# EAGLE design TM (EAGLE 6.5.0)
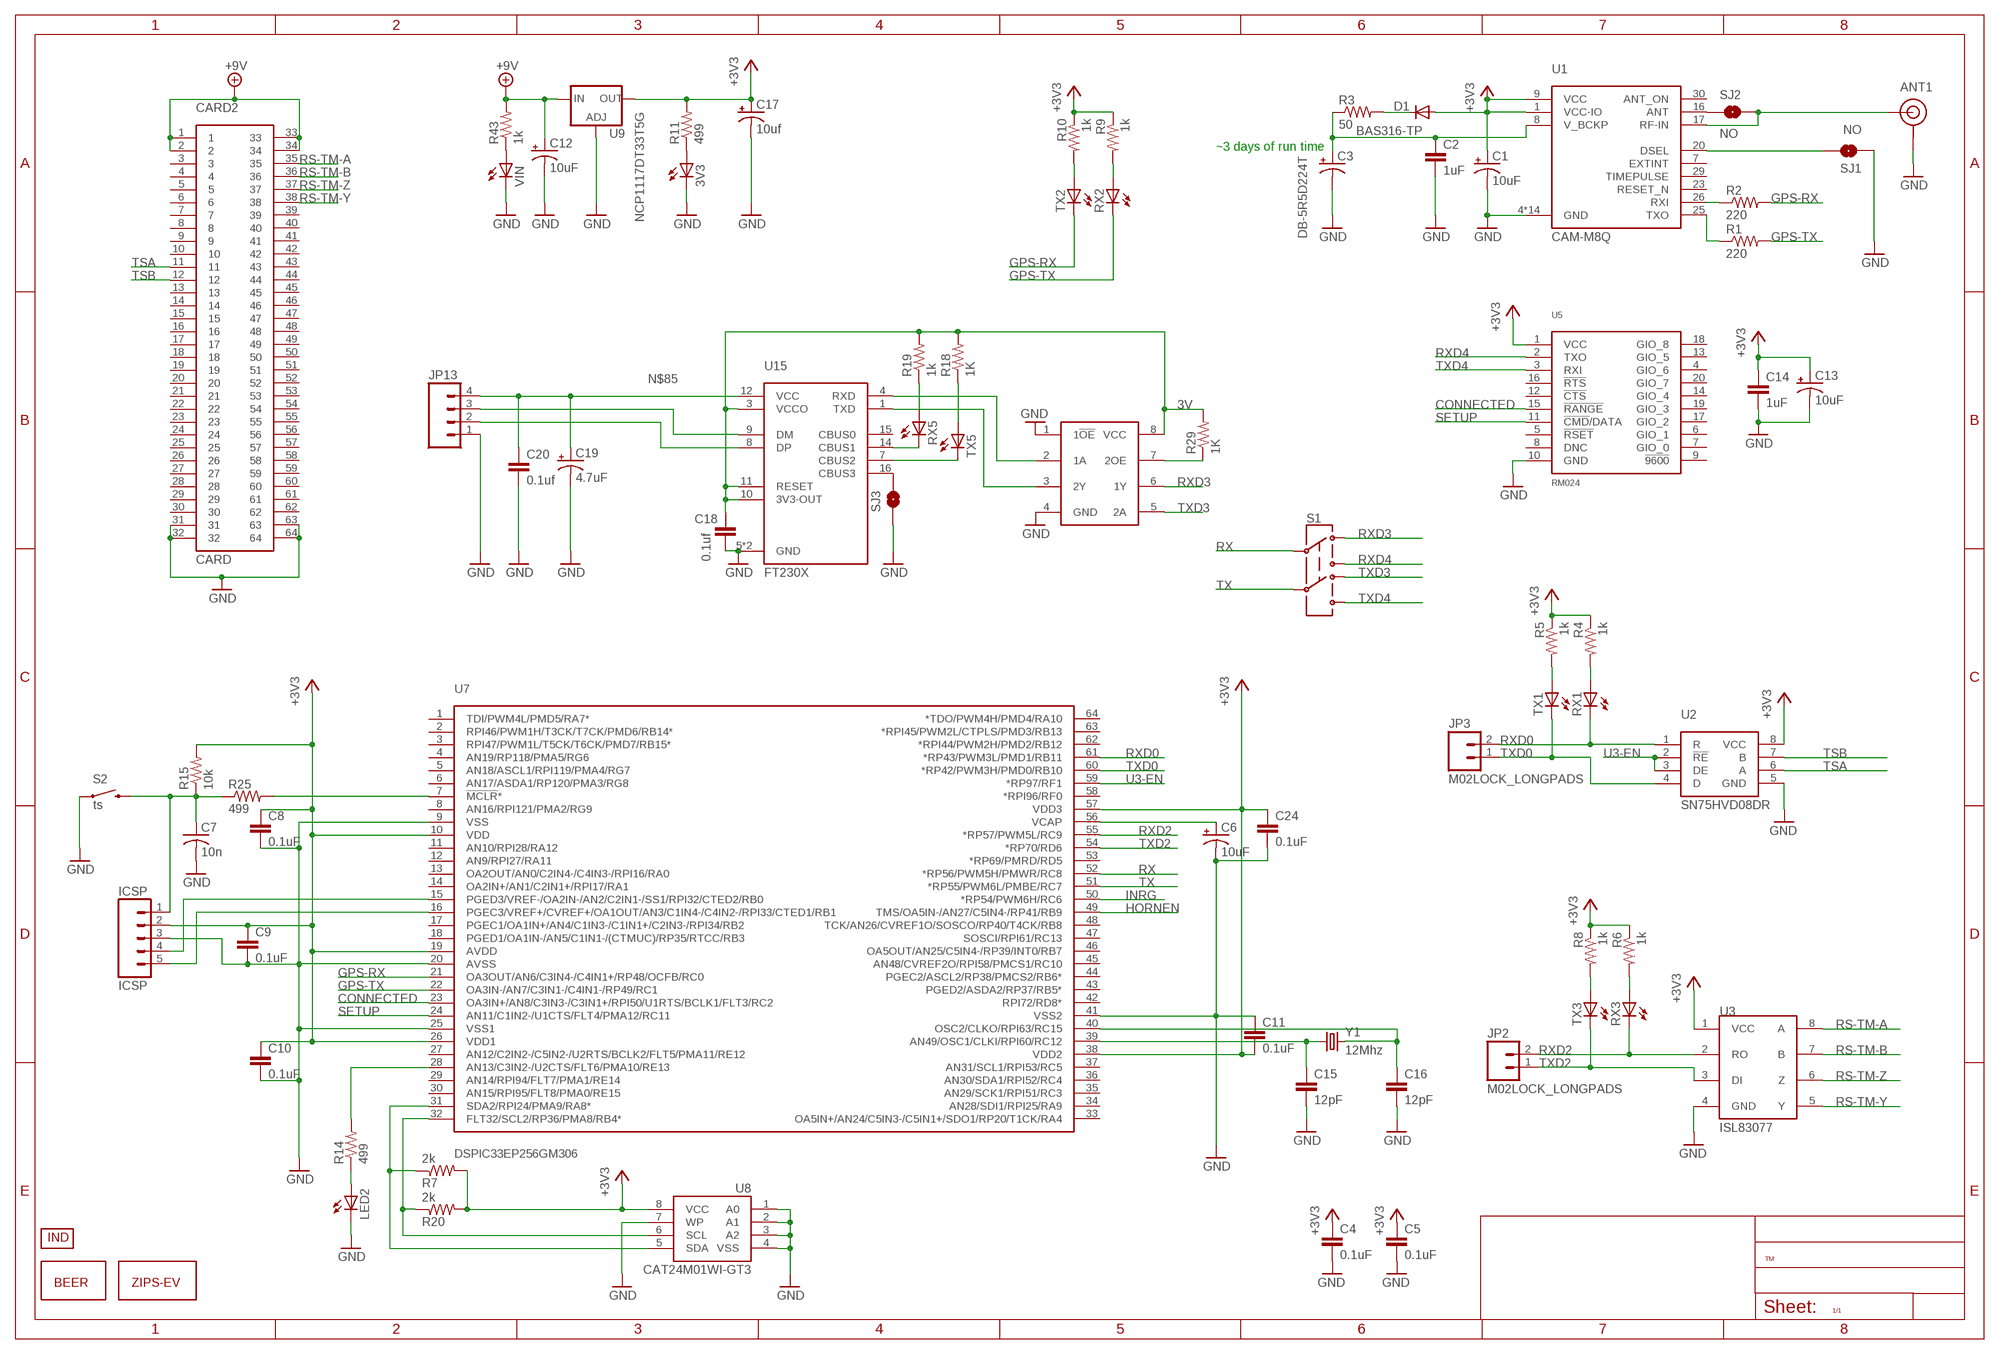
[diagram p0: schematic, sheet 1]

## Parts
3V3  LEDCHIP-LED0805  [CHIP-LED0805]
ANT1  CONMCX002  SMA  [CONSMA002]
C1  10uF  CAP_POL1206  [EIA3216]
C2  1uF  CAP0805  [0805]
C3  DB-5R5D224T  [DB-5R5D224T]
C4  0.1uF  CAP0805  [0805]
C5  0.1uF  CAP0805  [0805]
C6  10uF  10UF-TANT  [EIA3216]
C7  10n  C-USC0805  [C0805]
C8  0.1uF  CAP0805  [0805]
C9  0.1uF  CAP0805  [0805]
C10  0.1uF  CAP0805  [0805]
C11  0.1uF  CAP0805  [0805]
C12  10uF  CAP_POL7343  [EIA7343]
C13  10uF  CAP_POL1206  [EIA3216]
C14  1uF  CAP0805  [0805]
C15  12pF  CAP0805  [0805]
C16  12pF  CAP0805  [0805]
C17  10uf  CAP_POL3528  [EIA3528]
C18  0.1uf  CAP0805  [0805]
C19  4.7uF  CAP_POL1206  [EIA3216]
C20  0.1uf  CAP0805  [0805]
C24  0.1uF  CAP0805  [0805]
CARD2  CARD  [CARD-64]
D1  BAS316-TP  DIODESOD  [SOD-323]
ICSP  ICSP  M05LOCK_LONGPADS  [1X05_LOCK_LONGPADS]
JP2  M02LOCK_LONGPADS  [1X02_LOCK_LONGPADS]
JP3  M02LOCK_LONGPADS  [1X02_LOCK_LONGPADS]
JP13  M04POLAR_LOCK  [MOLEX-1X4_LOCK]
LED2  LEDCHIP-LED0805  [CHIP-LED0805]
R1  220  RESISTOR0805-RES  [0805]
R2  220  RESISTOR0805-RES  [0805]
R3  50  RESISTOR2010  [R2010]
R4  1k  RESISTOR0805-RES  [0805]
R5  1k  RESISTOR0805-RES  [0805]
R6  1k  RESISTOR0805-RES  [0805]
R7  2k  RESISTOR0805-RES  [0805]
R8  1k  RESISTOR0805-RES  [0805]
R9  1k  RESISTOR0805-RES  [0805]
R10  1k  RESISTOR0805-RES  [0805]
R11  499  R-US_R0805  [R0805]
R14  499  RESISTOR0805-RES  [0805]
R15  10k  RESISTOR0805-RES  [0805]
R18  1K  R-US_R0805  [R0805]
R19  1k  R-US_R0805  [R0805]
R20  2k  RESISTOR0805-RES  [0805]
R25  499  RESISTOR0805-RES  [0805]
R29  1K  R-US_R0805  [R0805]
R43  1k  R-US_R0805  [R0805]
RX1  LEDCHIP-LED0805  [CHIP-LED0805]
RX2  LEDCHIP-LED0805  [CHIP-LED0805]
RX3  LEDCHIP-LED0805  [CHIP-LED0805]
RX5  LEDCHIPLED_0805  [CHIPLED_0805]
S1  SWITCH-DPDTEG2211  [EG2211]
S2  ts  SWITCH-MOMENTARY-2SIDE_EZ  [TACTILE-PTH-SIDEEZ]
SJ1  NO  SOLDERJUMPERNO  [SJ_2S-NO]
SJ2  NO  SOLDERJUMPERNO  [SJ_2S-NO]
SJ3  JUMPER-PAD-2-NOYES_SILK  [PAD-JUMPER-2-NO_YES_SILK]
TX1  LEDCHIP-LED0805  [CHIP-LED0805]
TX2  LEDCHIP-LED0805  [CHIP-LED0805]
TX3  LEDCHIP-LED0805  [CHIP-LED0805]
TX5  LEDCHIPLED_0805  [CHIPLED_0805]
U1  CAM-M8Q  [CAM-M8Q]
U2  SN75HVD08DR  [SO-8]
U3  ISL83077  [SO08]
U4  SN74LVC2G241DCTR  [VFSOP-8]
U5  RM024  [RM024-TH]
U7  DSPIC33EP256GM306  [TQFP-64]
U8  CAT24M01WI-GT3  EEPROM-I2CSMD  [SO08]
U9  NCP1117DT33T5G  V_REG_317DPACK  [V-REG_DPACK]
U15  FT230X  [SSOP-16]
U$1  BEERM  [B-M]
U$2  LOGO  [L-MS]
U$3  INDPK1  [PICKIT-PIN-1]
VIN  LEDCHIP-LED0805  [CHIP-LED0805]
Y1  12Mhz  CRYSTAL5X3  [CRYSTAL-SMD-5X3]

## Nets
3V: C18.1 R18.2 R19.2 R29.2 U4.8(VCC) U15.3(VCCO) U15.10(3V3-OUT) U15.11(RESET)
+3V3: C1.A(+) C4.1 C5.1 C8.1 C9.1 C10.1 C11.2 C13.A(+) C14.1 C17.A(+) C24.1 D1.2(A) ICSP.2 R4.1 R5.1 R6.1 R7.2 R8.1 R9.1 R10.1 R11.2 R15.2 R20.2 U1.1(VCC-IO) U1.9(VCC) U2.8(VCC) U3.1(VCC) U5.1(VCC) U7.10(VDD) U7.19(AVDD) U7.26(VDD1) U7.38(VDD2) U7.57(VDD3) U8.8(VCC) U9.4(OUT)
+9V: C12.A(+) CARD2.1 CARD2.2 CARD2.33 CARD2.34 R43.2 U9.3(IN)
CONNECTED: U5.15(!RANGE) U7.23(OA3IN+/AN8/C3IN3-/C3IN1+/RPI50/U1RTS/BCLK1/FLT3/RC2)
GND: 3V3.C ANT1.1(GND) ANT1.2(GND) ANT1.3(GND) ANT1.4(GND) C1.C(-) C2.2 C3.- C4.2 C5.2 C6.C(-) C7.2 C8.2 C9.2 C10.2 C11.1 C12.C(-) C13.C(-) C14.2 C15.2 C16.2 C17.C(-) C18.2 C19.C(-) C20.2 C24.2 CARD2.31 CARD2.32 CARD2.63 CARD2.64 ICSP.3 JP13.1 LED2.C S2.1 SJ1.1 SJ3.1 U1.4(GND) U1.5(GND) U1.10(GND) U1.11(GND) U1.12(GND) U1.13(GND) U1.14(GND) U1.15(GND) U1.18(GND) U1.19(GND) U1.21(GND) U1.22(GND) U1.27(GND) U1.31(GND) U2.5(GND) U3.4(GND) U4.1(1!OE) U4.4(GND) U5.10(GND) U7.9(VSS) U7.20(AVSS) U7.25(VSS1) U7.41(VSS2) U8.1(A0) U8.2(A1) U8.3(A2) U8.4(VSS) U8.7(WP) U9.1(ADJ) U15.5(GND) U15.13(GND) VIN.C
GPS-RX: R2.2 TX2.C U7.21(OA3OUT/AN6/C3IN4-/C4IN1+/RP48/OCFB/RC0)
GPS-TX: R1.2 RX2.C U7.22(OA3IN-/AN7/C3IN1-/C4IN1-/RP49/RC1)
HORNEN: U7.49(TMS/OA5IN-/AN27/C5IN4-/RP41/RB9)
INRG: U7.50(*RP54/PWM6H/RC6)
N$1: R9.2 RX2.A
N$2: R1.1 U1.25(TXO)
N$3: ANT1.C(SIGNAL) SJ2.2 U1.17(RF-IN)
N$4: R2.1 U1.26(RXI)
N$5: SJ1.2 U1.20(DSEL)
N$6: D1.1(C) R3.2
N$7: 3V3.A R11.1
N$8: C2.1 C3.+ R3.1 U1.8(V_BCKP)
N$9: R6.2 RX3.A
N$10: R8.2 TX3.A
N$11: R18.1 TX5.A
N$12: R14.2 U7.28(AN13/C3IN2-/U2CTS/FLT6/PMA10/RE13)
N$13: C16.1 U7.40(OSC2/CLKO/RPI63/RC15) Y1.3
N$14: C15.1 U7.39(AN49/OSC1/CLKI/RPI60/RC12) Y1.1
N$15: LED2.A R14.1
N$16: R7.1 U7.31(SDA2/RPI24/PMA9/RA8*) U8.5(SDA)
N$17: SJ2.1 U1.16(ANT)
N$18: R19.1 RX5.A
N$19: TX5.C U15.7(CBUS2)
N$20: RX5.C U15.14(CBUS1)
N$21: U4.2(1A) U15.4(RXD)
N$22: R4.2 RX1.A
N$23: R5.2 TX1.A
N$24: R10.2 TX2.A
N$27: U4.3(2Y) U15.1(TXD)
N$28: JP13.3 U15.9(DM)
N$32: R20.1 U7.32(FLT32/SCL2/RP36/PMA8/RB4*) U8.6(SCL)
N$33: R43.1 VIN.A
N$61: JP13.2 U15.8(DP)
N$62: SJ3.2 U15.16(CBUS3)
N$69: R29.1 U4.7(2OE)
N$85: C19.A(+) C20.1 JP13.4 U15.12(VCC)
N$86: C7.1 ICSP.1 R15.1 R25.1 S2.2
N$87: R25.2 U7.7(!MCLR!*)
N$88: C6.A(+) U7.56(VCAP)
N$90: ICSP.4 U7.15(PGED3/VREF-/OA2IN-/AN2/C2IN1-/SS1/RPI32/CTED2/RB0)
N$91: ICSP.5 U7.16(PGEC3/VREF+/CVREF+/OA1OUT/AN3/C1IN4-/C4IN2-/RPI33/CTED1/RB1)
RS-TM-A: CARD2.35 U3.8(A)
RS-TM-B: CARD2.36 U3.7(B)
RS-TM-Y: CARD2.38 U3.5(Y)
RS-TM-Z: CARD2.37 U3.6(Z)
RX: S1.P1 U7.52(*RP56/PWM5H/PMWR/RC8)
RXD0: JP3.2 RX1.C U2.1(R) U7.61(*RP43/PWM3L/PMD1/RB11)
RXD2: JP2.2 RX3.C U3.2(RO) U7.55(*RP57/PWM5L/RC9)
RXD3: S1.P1-TA U4.6(1Y)
RXD4: S1.P1-TB U5.2(TXO)
SETUP: U5.11(!CMD!/DATA) U7.24(AN11/C1IN2-/U1CTS/FLT4/PMA12/RC11)
TSA: CARD2.11 U2.6(A)
TSB: CARD2.12 U2.7(B)
TX: S1.P2 U7.51(*RP55/PWM6L/PMBE/RC7)
TXD0: JP3.1 TX1.C U2.4(D) U7.60(*RP42/PWM3H/PMD0/RB10)
TXD2: JP2.1 TX3.C U3.3(DI) U7.54(*RP70/RD6)
TXD3: S1.P2-TA U4.5(2A)
TXD4: S1.P2-TB U5.3(RXI)
U3-EN: U2.2(!RE) U2.3(DE) U7.59(*RP97/RF1)
Unconnected: CARD2.3 CARD2.4 CARD2.5 CARD2.6 CARD2.7 CARD2.8 CARD2.9 CARD2.10 CARD2.13 CARD2.14 CARD2.15 CARD2.16 CARD2.17 CARD2.18 CARD2.19 CARD2.20 CARD2.21 CARD2.22 CARD2.23 CARD2.24 CARD2.25 CARD2.26 CARD2.27 CARD2.28 CARD2.29 CARD2.30 CARD2.39 CARD2.40 CARD2.41 CARD2.42 CARD2.43 CARD2.44 CARD2.45 CARD2.46 CARD2.47 CARD2.48 CARD2.49 CARD2.50 CARD2.51 CARD2.52 CARD2.53 CARD2.54 CARD2.55 CARD2.56 CARD2.57 CARD2.58 CARD2.59 CARD2.60 CARD2.61 CARD2.62 U1.7(EXTINT) U1.23(RESET_N) U1.29(TIMEPULSE) U1.30(ANT_ON) U5.4(GIO_6) U5.5(!RSET) U5.6(GIO_1) U5.7(GIO_0) U5.8(DNC) U5.9(!9600) U5.12(!CTS) U5.13(GIO_5) U5.14(GIO_4) U5.16(!RTS) U5.17(GIO_2) U5.18(GIO_8) U5.19(GIO_3) U5.20(GIO_7) U7.1(TDI/PWM4L/PMD5/RA7*) U7.2(RPI46/PWM1H/T3CK/T7CK/PMD6/RB14*) U7.3(RPI47/PWM1L/T5CK/T6CK/PMD7/RB15*) U7.4(AN19/RP118/PMA5/RG6) U7.5(AN18/ASCL1/RPI119/PMA4/RG7) U7.6(AN17/ASDA1/RP120/PMA3/RG8) U7.8(AN16/RPI121/PMA2/RG9) U7.11(AN10/RPI28/RA12) U7.12(AN9/RPI27/RA11) U7.13(OA2OUT/AN0/C2IN4-/C4IN3-/RPI16/RA0) U7.14(OA2IN+/AN1/C2IN1+/RPI17/RA1) U7.17(PGEC1/OA1IN+/AN4/C1IN3-/C1IN1+/C2IN3-/RPI34/RB2) U7.18(PGED1/OA1IN-/AN5/C1IN1-/(CTMUC)/RP35/RTCC/RB3) U7.27(AN12/C2IN2-/C5IN2-/U2RTS/BCLK2/FLT5/PMA11/RE12) U7.29(AN14/RPI94/FLT7/PMA1/RE14) U7.30(AN15/RPI95/FLT8/PMA0/RE15) U7.33(OA5IN+/AN24/C5IN3-/C5IN1+/SDO1/RP20/T1CK/RA4) U7.34(AN28/SDI1/RPI25/RA9) U7.35(AN29/SCK1/RPI51/RC3) U7.36(AN30/SDA1/RPI52/RC4) U7.37(AN31/SCL1/RPI53/RC5) U7.42(RPI72/RD8*) U7.43(PGED2/ASDA2/RP37/RB5*) U7.44(PGEC2/ASCL2/RP38/PMCS2/RB6*) U7.45(AN48/CVREF2O/RPI58/PMCS1/RC10) U7.46(OA5OUT/AN25/C5IN4-/RP39/INT0/RB7) U7.47(SOSCI/RPI61/RC13) U7.48(TCK/AN26/CVREF1O/SOSCO/RP40/T4CK/RB8) U7.53(*RP69/PMRD/RD5) U7.58(*RPI96/RF0) U7.62(*RPI44/PWM2H/PMD2/RB12) U7.63(*RPI45/PWM2L/CTPLS/PMD3/RB13) U7.64(*TDO/PWM4H/PMD4/RA10) U15.15(CBUS0)

## Notes on the sheet
- ~3 days of run time

## Library data of the parts
3V3 LED2 RX1-RX3 RX5 TX1-TX3 TX5 VIN = adafruit:LED: LED OSRAM: - CHIPLED LG R971, LG N971, LY N971, LG Q971, LY Q971, LO R971, LY R971 LH N974, LH R974 LS Q976, LO Q976, LY Q976 LO Q996 - Hyper CHIPLED LW Q18S LB Q993, LB Q99A, LB R99A - SideLED LS A670, LO A670, LY A670, LG A670, LP A670 LB A673, LV A673, LT A673, LW A673 LH A674 LY A675 LS A676, LA A676, LO A676, LY A676, LW A676 LS A679, LY A679, LG A679 - Hyper Micro SIDELED® LS Y876, LA Y876, LO Y876, LY Y876 LT Y87S - SmartLED LW L88C, LW L88S LB L89C, LB L89S, LG L890 LS L89K, LO L89K, LY L89K LS L896, LA L896, LO L896, LY L896 - TOPLED LS T670, LO T670, LY T670, LG T670, LP T670 LSG T670, LSP T670, LSY T670, LOP T670, LYG T670 LG T671, LOG T671, LSG T671 LB T673, LV T673, LT T673, LW T673 LH T674 LS T676, LA T676, LO T676, LY T676, LB T676, LH T676, LSB T676, LW T676 LB T67C, LV T67C, LT T67C, LS T67K, LO T67K, LY T67K, LW E67C LS E67B, LA E67B, LO E67B, LY E67B, LB E67C, LV E67C, LT E67C LW T67C LS T679, LY T679, LG T679 LS T770, LO T770, LY T770, LG T770, LP T770 LB T773, LV T773, LT T773, LW T773 LH T774 LS E675, LA E675, LY E675, LS T675 LS T776, LA T776, LO T776, LY T776, LB T776 LHGB T686 LT T68C, LB T68C - Hyper Mini TOPLED® LB M676 - Mini TOPLED Santana® LG M470 LS M47K, LO M47K, LY M47K Source: http://www.osram.convergy.de/
ANT1 = FSAE Eletric:SMA
C1 C13 = SparkFun-Passives:CAP_POL: Capacitor Polarized These are standard SMD and PTH capacitors. Normally 10uF, 47uF, and 100uF in electrolytic and tantalum varieties. Always verify the external diameter of the through hole cap, it varies with capacity, voltage, and manufacturer. The EIA devices should be standard.
C2 C14 = SparkFun-Passives:CAP: Capacitor Standard 0603 ceramic capacitor, and 0.1" leaded capacitor.
C3 = FSAE Eletric:DB-5R5D224T
C4 C5 C8-C11 C15 C16 C24 = SparkFun-Capacitors:CAP: Capacitor Standard 0603 ceramic capacitor, and 0.1" leaded capacitor.
C6 = SparkFun-Capacitors:10UF-TANT: 10uF Tantalum SMT CAP-00811- 16V 10% (EIA-3216); PROD_ID: CAP-00811
C7 = adafruit:C-US: CAPACITOR, American symbol
C12 C17 = SparkFun-Capacitors:CAP_POL: Capacitor Polarized These are standard SMD and PTH capacitors. Normally 10uF, 47uF, and 100uF in electrolytic and tantalum varieties. Always verify the external diameter of the through hole cap, it varies with capacity, voltage, and manufacturer. The EIA devices should be standard.
C18 C20 = SparkFun:CAP: Capacitor Standard 0603 ceramic capacitor, and 0.1" leaded capacitor.
C19 = SparkFun:CAP_POL: Capacitor Polarized These are standard SMD and PTH capacitors. Normally 10uF, 47uF, and 100uF in electrolytic and tantalum varieties. Always verify the external diameter of the through hole cap, it varies with capacity, voltage, and manufacturer. The EIA devices should be standard.
CARD2 = FSAE Eletric:CARD
D1 = SparkFun-DiscreteSemi:DIODE: Diode These are standard reverse protection diodes and small signal diodes. SMA package can handle up to about 1A. SOD-323 can handle about 200mA. What the SOD-323 package when ordering, there are some mfgs out there that are 5-pin packages.
ICSP = SparkFun-Connectors:M05: Header 5 Standard 5-pin 0.1" header. Use with straight break away headers (SKU : PRT-00116), right angle break away headers (PRT-00553), swiss pins (PRT-00743), machine pins (PRT-00117), and female headers (PRT-00115). Molex polarized connector foot print use with SKU : PRT-08230 with associated crimp pins and housings.
JP2 JP3 = SparkFun-Connectors:M02: Standard 2-pin 0.1" header. Use with - straight break away headers ( PRT-00116) - right angle break away headers (PRT-00553) - swiss pins (PRT-00743) - machine pins (PRT-00117) - female headers (PRT-00115) Molex polarized connector foot print use with: PRT-08233 with associated crimp pins and housings. 2.54_SCREWTERM for use with PRT-10571. 3.5mm Screw Terminal footprints for PRT-08084 5mm Screw Terminal footprints for use with PRT-08433
JP13 = SparkFun-Connectors:M04: Header 4 Standard 4-pin 0.1" header. Use with straight break away headers (SKU : PRT-00116), right angle break away headers (PRT-00553), swiss pins (PRT-00743), machine pins (PRT-00117), and female headers (PRT-00115). Molex polarized connector foot print use with SKU : PRT-08231 with associated crimp pins and housings. 1MM SMD Version SKU: PRT-10208
R1-R10 R14 R15 R20 = SparkFun-Passives:RESISTOR: Resistor Basic schematic elements and footprints for 0603, 1206, and PTH resistors.
R11 R18 R19 R29 R43 = adafruit:R-US_: RESISTOR, American symbol
R25 = SparkFun-Resistors:RESISTOR: Resistor Basic schematic elements and footprints for 0603, 1206, and PTH resistors.
S1 = SparkFun-Electromechanical:SWITCH-DPDT: DPDT Version of the COM-00597
S2 = SparkFun-Electromechanical:SWITCH-MOMENTARY-2: Various NO switches- pushbuttons, reed, etc
SJ1 SJ2 = SparkFun-Passives:SOLDERJUMPER: Solder Jumper Standard SMD solder jumper. Used to automate production. Two varients : Normally Open and Normally Closed are the same, but have different paste layers. NC will have a large amount of paste and should jumper during reflow.
SJ3 = SparkFun-Passives:JUMPER-PAD-2-NO
U1 = FSAE Eletric:CAM-M8Q
U2 = FSAE Eletric:SN75HVD08DR
U3 = NASA_LIB:ISL83077
U4 = Cleaverbrooks:SN74LVC2G241DCTR
U5 = FSAE Eletric:RM024
U7 = FSAE Eletric:DSPIC33EP256GM306
U8 = SparkFun-DigitalIC:EEPROM-I2C: I2C EEPROM chips, 24LC256 (and others)
U9 = SparkFun-PowerIC:V_REG_317: Voltage Regulator Standard LM317 adjustable voltage regulator. AOI (Adjust Output Input). Google 'LM317 Calculator' for easy to use app to get the two resistor values needed. 240/720 for 5V output. 240/390 for 3.3V output. Spark Fun Electronics SKU : COM-00527
U15 = FSAE Eletric:FT230X
U$1 = Pic:BEER
U$2 = Pic:LOGO
U$3 = FSAE Eletric:IND
Y1 = SparkFun-FreqCtrl:CRYSTAL: Various standard crystals. Proven footprints. Spark Fun Electronics SKU : COM-00534

## Board
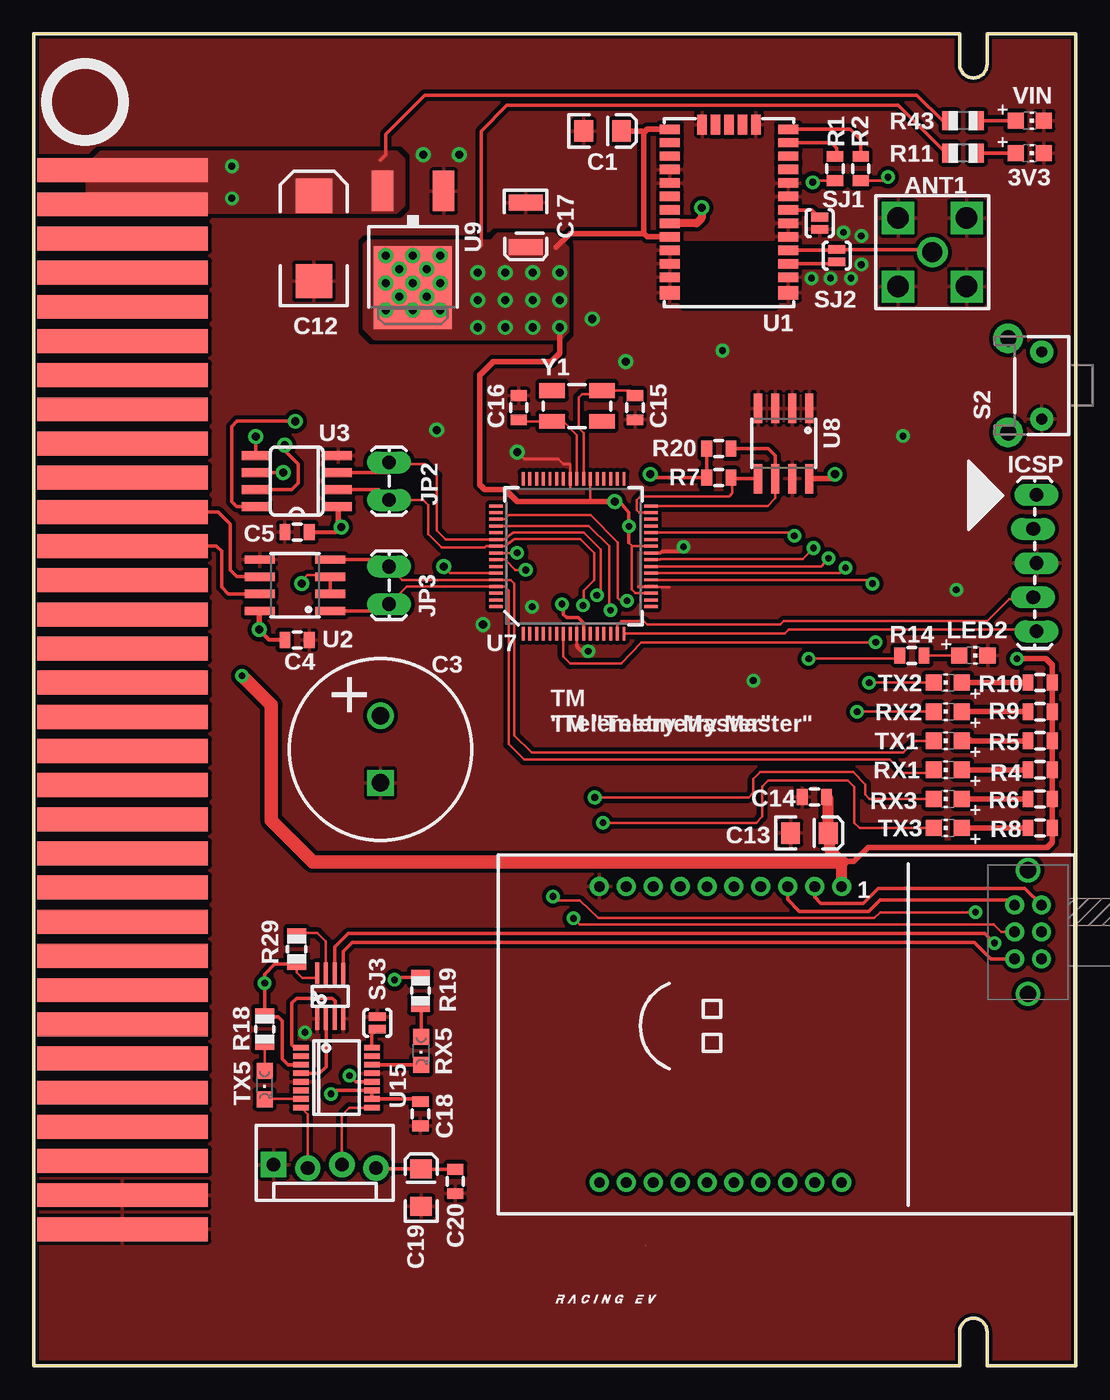
[diagram p1: board, top side]
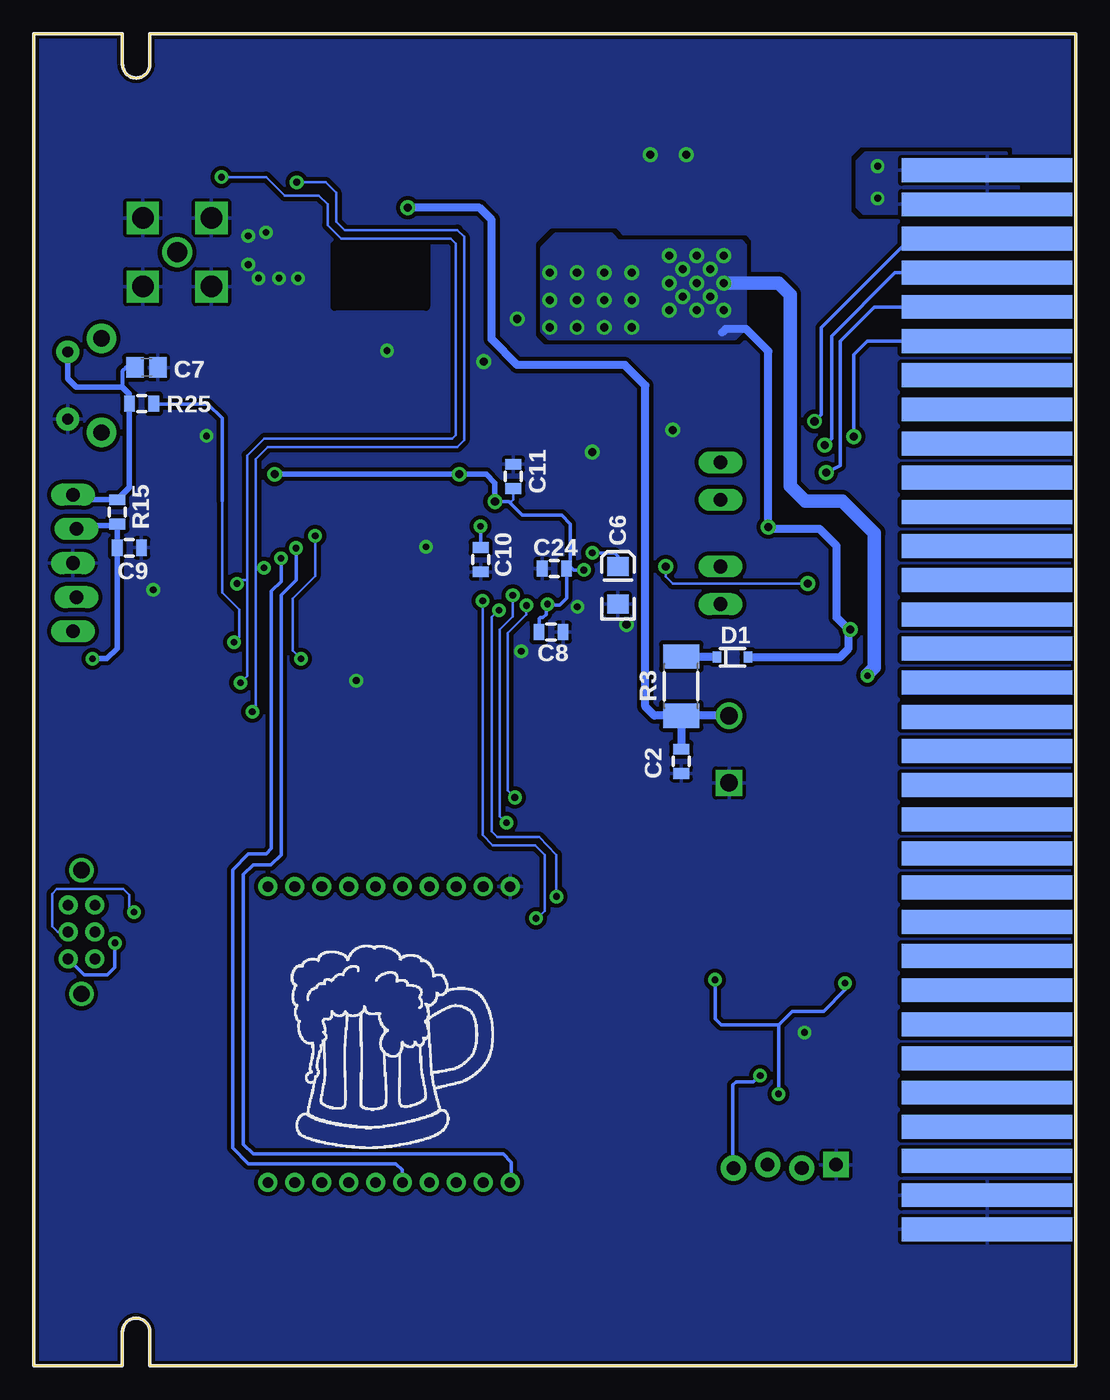
[diagram p2: board, bottom side, seen from below]

Size 77.47 x 99.06 mm. Coordinates in mm from the lower left corner, seen from the top.
Copper layers (1*16): Top 0.035mm / dielectric 1.5mm / Bottom 0.035mm
Design rules "SparkFun *": minimum track width 8mil, minimum drill 19mil, track to track 8mil, track to pad 8mil, pad to pad 8mil, via to via 8mil, smd to smd 8mil, copper to edge 10mil, drill to drill 8mil, minimum pad ring 12mil, minimum via ring 10mil, stop-mask expansion 4mil, vias tented up to drill 25mil, thermal gap 10mil

### Footprints (pad centres in the part's own frame; a part is rotated, then mirrored left to right if it is on the bottom)
CHIP-LED0805 = smd 1.2 x 1.2: A 0,-1.05; C 0,1.05
CONSMA002 = drill 1.6 square: 1 -2.55,2.55; 2 2.55,2.55; 3 2.55,-2.55; 4 -2.55,-2.55 | drill 1.5: C 0,0
EIA3216 = smd 1.4 x 1.6: A 1.4,0; C -1.4,0
0805 = smd 0.8 x 1.2: 1 -0.9,0; 2 0.9,0
DB-5R5D224T = drill 1.3: + 2.5,0 | drill 1.3 square: - -2.5,0
C0805 = smd 1.3 x 1.5: 1 -0.85,0; 2 0.85,0
EIA7343 = smd 2.55 x 2.7: A 3.17,0; C -3.17,0
EIA3528 = smd 1.2 x 2.5: A 1.65,0; C -1.65,0
CARD-64 = smd 1.778 x 12.7: 1 10.16,6.604; 2 12.7,6.604; 3 15.24,6.604; 4 17.78,6.604; 5 20.32,6.604; 6 22.86,6.604; 7 25.4,6.604; 8 27.94,6.604; 9 30.48,6.604; 10 33.02,6.604; 11 35.56,6.604; 12 38.1,6.604; 13 40.64,6.604; 14 43.18,6.604; 15 45.72,6.604; 16 48.26,6.604; 17 50.8,6.604; 18 53.34,6.604; 19 55.88,6.604; 20 58.42,6.604; 21 60.96,6.604; 22 63.5,6.604; 23 66.04,6.604; 24 68.58,6.604; 25 71.12,6.604; 26 73.66,6.604; 27 76.2,6.604; 28 78.74,6.604; 29 81.28,6.604; 30 83.82,6.604; 31 86.36,6.604; 32 88.9,6.604 | smd 1.778 x 12.7 bottom: 33 10.16,6.604; 34 12.7,6.604; 35 15.24,6.604; 36 17.78,6.604; 37 20.32,6.604; 38 22.86,6.604; 39 25.4,6.604; 40 27.94,6.604; 41 30.48,6.604; 42 33.02,6.604; 43 35.56,6.604; 44 38.1,6.604; 45 40.64,6.604; 46 43.18,6.604; 47 45.72,6.604; 48 48.26,6.604; 49 50.8,6.604; 50 53.34,6.604; 51 55.88,6.604; 52 58.42,6.604; 53 60.96,6.604; 54 63.5,6.604; 55 66.04,6.604; 56 68.58,6.604; 57 71.12,6.604; 58 73.66,6.604; 59 76.2,6.604; 60 78.74,6.604; 61 81.28,6.604; 62 83.82,6.604; 63 86.36,6.604; 64 88.9,6.604
SOD-323 = smd 0.63 x 0.83: 1 -1.15,0; 2 1.15,0
1X05_LOCK_LONGPADS = drill 1.016 long: 1 0,0; 2 2.54,-0.254; 3 5.08,0; 4 7.62,-0.254; 5 10.16,0
1X02_LOCK_LONGPADS = drill 1.016 long: 1 -0.127,0; 2 2.667,0
MOLEX-1X4_LOCK = drill 1.016 pad 1.88 square: 1 0,0.127 | drill 1.016 pad 1.88: 2 2.54,-0.127; 3 5.08,0.127; 4 7.62,-0.127
R2010 = smd 1.8 x 2.7: 1 -2.2,0; 2 2.2,0
R0805 = smd 1.1 x 1.4: 1 -1,0; 2 1,0
CHIPLED_0805 = smd 1.2 x 1.2: A 0,-1.05; C 0,1.05
EG2211 = drill 0.8: P1 -1,0; P1-TA -1,2; P1-TB -1,-2; P2 1,0; P2-TA 1,2; P2-TB 1,-2 | drill 1.2: P$7 0,4.6; P$8 0,-4.6
TACTILE-PTH-SIDEEZ = drill 0.8 pad 1.7: 1 -2.5,0; 2 2.5,0 | drill 1.2 pad 2.2: ANCHOR1 -3.5,2.5; ANCHOR2 3.5,2.5
SJ_2S-NO = smd 0.635 x 1.27: 1 -0.45,0; 2 0.45,0
PAD-JUMPER-2-NO_YES_SILK = smd 0.635 x 1.27: 1 -0.45,0; 2 0.45,0
CAM-M8Q = smd 1.5 x 0.7: 1 4.4,0; 2 4.4,1; 3 4.4,2; 4 4.4,3; 5 4.4,4; 6 4.4,5; 7 4.4,6; 8 4.4,7; 9 4.4,8; 10 4.4,9; 11 4.4,10; 12 4.4,11; 15 -4.4,11; 16 -4.4,10; 17 -4.4,9; 18 -4.4,8; 19 -4.4,7; 20 -4.4,6; 21 -4.4,5; 22 -4.4,4; 23 -4.4,3; 24 -4.4,2; 25 -4.4,1; 26 -4.4,0 | smd 1.5 x 1: 13 4.4,12.15; 14 -4.4,12.15 | smd 0.7 x 1.5: 27 -2,-0.35; 28 -1,-0.35; 29 0,-0.35; 30 1,-0.35; 31 2,-0.35
SO-8 = smd 0.61 x 2.21: 1 -1.905,-2.616; 2 -0.635,-2.616; 3 0.635,-2.616; 4 1.905,-2.616; 5 1.905,2.616; 6 0.635,2.616; 7 -0.635,2.616; 8 -1.905,2.616
SO08 = smd 0.66 x 2.032: 1 -1.905,-3.073; 2 -0.635,-3.073; 3 0.635,-3.073; 4 1.905,-3.073; 5 1.905,3.073; 6 0.635,3.073; 7 -0.635,3.073; 8 -1.905,3.073
VFSOP-8 = smd 0.3 x 1.6: 1 -0.98,-1.7; 2 -0.33,-1.7; 3 0.33,-1.7; 4 0.98,-1.7; 5 0.97,1.69; 6 0.325,1.7; 7 -0.33,1.7; 8 -0.98,1.71
RM024-TH = drill 0.8: 1 9,11; 2 7,11; 3 5,11; 4 3,11; 5 1,11; 6 -1,11; 7 -3,11; 8 -5,11; 9 -7,11; 10 -9,11; 11 -9,-11; 12 -7,-11; 13 -5,-11; 14 -3,-11; 15 -1,-11; 16 1,-11; 17 3,-11; 18 5,-11; 19 7,-11; 20 9,-11
TQFP-64 = smd 0.22 x 1: 1 -3.75,-5.75; 2 -3.25,-5.75; 3 -2.75,-5.75; 4 -2.25,-5.75; 5 -1.75,-5.75; 6 -1.25,-5.75; 7 -0.75,-5.75; 8 -0.25,-5.75; 9 0.25,-5.75; 10 0.75,-5.75; 11 1.25,-5.75; 12 1.75,-5.75; 13 2.25,-5.75; 14 2.75,-5.75; 15 3.25,-5.75; 16 3.75,-5.75; 33 3.75,5.75; 34 3.25,5.75; 35 2.75,5.75; 36 2.25,5.75; 37 1.75,5.75; 38 1.25,5.75; 39 0.75,5.75; 40 0.25,5.75; 41 -0.25,5.75; 42 -0.75,5.75; 43 -1.25,5.75; 44 -1.75,5.75; 45 -2.25,5.75; 46 -2.75,5.75; 47 -3.25,5.75; 48 -3.75,5.75 | smd 1 x 0.22: 17 5.75,-3.75; 18 5.75,-3.25; 19 5.75,-2.75; 20 5.75,-2.25; 21 5.75,-1.75; 22 5.75,-1.25; 23 5.75,-0.75; 24 5.75,-0.25; 25 5.75,0.25; 26 5.75,0.75; 27 5.75,1.25; 28 5.75,1.75; 29 5.75,2.25; 30 5.75,2.75; 31 5.75,3.25; 32 5.75,3.75; 49 -5.75,3.75; 50 -5.75,3.25; 51 -5.75,2.75; 52 -5.75,2.25; 53 -5.75,1.75; 54 -5.75,1.25; 55 -5.75,0.75; 56 -5.75,0.25; 57 -5.75,-0.25; 58 -5.75,-0.75; 59 -5.75,-1.25; 60 -5.75,-1.75; 61 -5.75,-2.25; 62 -5.75,-2.75; 63 -5.75,-3.25; 64 -5.75,-3.75
SO08' = smd 0.61 x 2.21: 1 -1.905,-2.616; 2 -0.635,-2.616; 3 0.635,-2.616; 4 1.905,-2.616; 5 1.905,2.616; 6 0.635,2.616; 7 -0.635,2.616; 8 -1.905,2.616
V-REG_DPACK = smd 1.6 x 3: 1 -2.28,-4.8; 3 2.28,-4.8 | smd 5.8 x 6.2: 4 0,2.38
SSOP-16 = smd 0.419 x 1.143: 1 -2.223,-2.642; 2 -1.587,-2.642; 3 -0.953,-2.642; 4 -0.318,-2.642; 5 0.318,-2.642; 6 0.953,-2.642; 7 1.587,-2.642; 8 2.223,-2.642; 9 2.223,2.642; 10 1.587,2.642; 11 0.953,2.642; 12 0.318,2.642; 13 -0.318,2.642; 14 -0.953,2.642; 15 -1.587,2.642; 16 -2.223,2.642
CRYSTAL-SMD-5X3 = smd 1.9 x 1.1: 1 -1.85,-1.15; 2 1.85,-1.15; 3 1.85,1.15; 4 -1.85,1.15

### Placement (x,y rotation side)
3V3  74.04,90.17 270 top
ANT1  66.8,82.8 0 top
C1  42.29,91.82 0 top
C2  29.34,44.96 270 bottom
C3  25.78,45.85 90 top
C4  19.58,53.98 0 top
C5  19.58,62 180 top
C6  34.04,58.04 90 bottom
C7  69.09,74.24 0 bottom
C8  39.01,54.56 0 bottom
C9  70.36,60.83 0 bottom
C10  44.25,59.94 270 bottom
C11  41.81,66.14 270 bottom
C12  20.83,83.82 90 top
C13  57.66,39.62 0 top
C14  58.04,42.29 180 top
C15  44.7,71.25 270 top
C16  36.07,71.25 90 top
C17  36.58,84.84 270 top
C18  28.75,18.75 270 top
C19  28.8,13.26 90 top
C20  31.34,13.72 270 top
C24  38.76,59.28 180 bottom
CARD2  0,99.06 270 top
D1  25.53,52.7 0 bottom
ICSP  74.55,64.77 270 top
JP2  26.42,67.06 270 top
JP3  26.42,59.31 270 top
JP13  17.83,14.83 0 top
LED2  69.85,52.83 270 top
R1  59.56,89.03 270 top
R2  61.47,89.03 270 top
R3  29.34,50.55 90 bottom
R4  74.8,44.32 180 top
R5  74.8,46.48 180 top
R6  74.8,42.16 180 top
R7  50.93,66.04 180 top
R8  74.8,40.01 180 top
R9  74.8,48.64 180 top
R10  74.8,50.8 180 top
R11  69.09,90.17 180 top
R14  65.28,52.83 180 top
R15  71.25,63.5 270 bottom
R18  17.17,25.04 90 top
R19  28.75,27.89 90 top
R20  50.93,68.2 180 top
R25  69.44,71.55 0 bottom
R29  19.56,30.99 270 top
R43  69.09,92.58 180 top
RX1  67.94,44.32 90 top
RX2  67.94,48.64 90 top
RX3  67.94,42.16 90 top
RX5  28.8,23.42 180 top
S1  73.91,32.26 180 top
S2  74.93,72.9 90 top
SJ1  58.42,84.96 90 top
SJ2  59.69,82.55 90 top
SJ3  25.55,25.5 270 top
TX1  67.94,46.48 90 top
TX2  67.94,50.8 90 top
TX3  67.94,40.01 90 top
TX5  17.17,20.88 180 top
U1  51.69,91.95 180 top
U2  19.43,58.04 90 top
U3  19.56,65.79 90 top
U4  22.05,27.48 0 top
U5  51.05,24.64 0 top
U7  40.13,60.2 0 top
U8  CAT24M01WI-GT3  [SO08']  55.75,68.58 180 top
U9  28.19,82.55 180 top
U15  22.5,21.44 270 top
U$1  58.32,16.15 0 bottom
U$2  35.81,3.86 0 top
U$3  72.03,64.72 90 top
VIN  74.04,92.58 270 top
Y1  40.39,71.37 180 top

### Tracks (layer width: path | path; a pad name or v marks a point on that pad's centre or on a via)
3V  (via drill 0.5)
  Top 0.203: R29.2 19.56,29.26 19.96,28.85 20.88,28.85 21.08,28.65 21.08,29.18 U4.8
  Top 0.254: R29.2 19.44,29.87 17.93,29.87 17.17,29.11 v17.17,28.45 R18.2 17.26,25.96 18.19,25.96 18.49,25.65 18.49,22.81 18.91,22.39 U15.3 | C18.1 28.55,19.85 U15.10 U15.11 22.36,20.48 v22.1,20.22 | R19.2 27.01,28.89 v26.82,28.7
  Bottom 0.254: v22.1,20.22 22.1,25.3 | 22.1,25.3 22.1,25.35 21.08,26.36 18.75,26.36 17.17,27.94 v17.17,28.45 | v26.82,28.7 26.82,25.81 26.36,25.35 22.15,25.35 22.1,25.3
+3V3  (via drill 0.5, 0.6)
  Top 0.203: U7.38 41.38,64.28 41.4,64.26 | U7.57 35.05,59.95 35.81,59.18 v36.58,59.18 | U7.26 44.51,60.95 | 44.51,60.95 44.25,61.21 | U7.19 44.71,57.45 44.45,57.71 44.45,60.88 44.51,60.95
  Top 0.254: R20.2 R7.2 46.1,66.04 v45.85,66.29 | R11.2 67.82,90.17 64.26,93.73 35.18,93.73 33.27,91.82 33.27,83.31 33.02,83.06 | U7.10 40.88,55.23 40.49,55.63 39.62,55.63 39.37,55.88 39.37,56.54 v39.27,56.64 | 44.25,61.21 v44.25,62.43 44.25,63.45 43.59,64.21 43.23,64.21 v43.18,64.26
  Top 0.305: C5.1 22.5,62 v22.86,62.36 | C4.1 17.53,53.98 v16.76,54.74
  Top 0.406: U3.1 22.63,62.59 v22.86,62.36 | v16.76,54.74 16.76,56.08 U2.8 | U1.9 45.59,83.95 45.34,84.2 | 45.34,84.2 45.34,91.69 | 45.34,91.69 45.59,91.95 U1.1 | C1.A 45.21,91.82 45.34,91.69 | 45.34,84.2 39.88,84.2 38.86,83.19 | U8.8 59.23,65.96 v59.56,66.29 | v39.12,77.22 39.12,75.31 38.48,74.68 34.16,74.68 33.15,73.66 33.15,65.53 33.53,65.15 35.05,65.15 35.94,64.26 41.4,64.26 v43.18,64.26 | 60.05,37.48 60.06,37.49 60.96,37.49 62.03,38.56 75.34,38.56 75.7,38.92 75.7,39.42 R8.1 R6.1 R4.1 R5.1 R9.1 R10.1 75.7,52.11 75.23,52.58 v73.1,52.58
  Top 0.813: U5.1 60.05,37.48 59.18,38.35 59.18,39.5 C13.A 59.06,42.17 C14.1
  Top 1.016: 60.05,37.48 20.73,37.48 17.68,40.54 17.68,49.12 v15.49,51.31
  Bottom 0.203: C11.2 41.81,64.41 41.96,64.26 42.32,64.26 | C24.1 37.74,59.28 37.59,59.44
  Bottom 0.254: v36.58,59.18 37.34,59.18 37.59,59.44 37.59,62.61 38.23,63.25 41.15,63.25 42.16,64.26 42.32,64.26 v43.18,64.26 43.23,63.96 | C8.1 39.88,54.6 39.88,55.58 39.83,55.63 39.62,55.63 39.37,55.88 39.37,56.54 v39.27,56.64 39.22,56.59 38.35,56.59 37.86,57.09 C24.1 | C10.1 v44.25,62.43
  Bottom 0.406: v59.56,66.29 v45.85,66.29 43.81,66.29 43.18,65.66 v43.18,64.26 | C9.1 71.26,61.42 | 71.26,61.42 71.26,62.59 R15.2 71.36,62.48 73.28,62.48 73.53,62.23 ICSP.2 | v73.1,52.58 72.03,52.58 71.27,53.34 71.27,61.4 71.26,61.42
  Bottom 0.61: D1.2 17.53,52.7 16.89,53.34 16.89,54.61 v16.76,54.74 16.89,54.74 17.78,55.63 17.78,60.96 19.05,62.23 22.73,62.23 v22.86,62.36 22.86,75.44 24.51,77.09 26.04,77.09 26.29,76.83
  Bottom 1.016: v15.49,51.31 15.49,51.41 14.99,51.92 14.99,61.92 17.37,64.31 20.12,64.31 21.23,65.43 21.23,79.65 22.1,80.52 v26.16,80.52
  other vias: 26.16,82.55 28.19,82.55 30.23,82.55 27.18,81.53 29.21,81.53 28.19,80.52 30.23,80.52 27.18,79.5 29.21,79.5 28.19,78.49 26.16,78.49 30.23,78.49 33.02,81.28 35.05,81.28 37.08,81.28 39.12,81.28 33.02,79.25 35.05,79.25 37.08,79.25 39.12,79.25 33.02,77.22 35.05,77.22 37.08,77.22
  pour Top (no thermals): 24.89,83.57 34.04,83.57 34.54,84.07 38.61,84.07 39.62,83.06 39.62,76.96 39.12,76.45 25.4,76.45 24.64,77.22 24.64,83.31
  pour Bottom: 24.64,83.31 24.89,83.57 34.04,83.57 34.54,84.07 38.61,84.07 39.62,83.06 39.62,76.96 39.12,76.45 25.4,76.45 24.64,77.22
+9V  (via drill 0.5)
  Top 0.254: R43.2 67.56,92.58 65.66,94.49 29.08,94.49 26.16,91.57 26.16,90.04 25.78,89.66
  other vias: 14.73,89.2 14.73,86.82
  pour Top (no thermals): 4.32,85.85 26.92,85.85 27.43,86.36 27.43,89.66 26.92,90.17 5.08,90.17 4.06,89.15 4.06,86.11
  pour Bottom: 4.27,85.9 4.27,89.26 5.18,90.17 15.65,90.17 16.26,89.56 16.26,86.16 15.8,85.7 4.47,85.7
CONNECTED  (via drill 0.5)
  Top 0.203: U7.23 58.53,59.45 v59.08,60.05
  Bottom 0.254: v59.08,60.05 59.08,58.32 59.79,57.61 59.79,38.46 60.2,38.05 61.52,38.05 62.69,36.88 62.69,16.2 61.52,15.04 50.55,15.04 50.09,14.58 50.09,13.67 U5.15
GND  (via drill 0.5, 0.6)
  Top 0.203: U7.41 | U7.41 39.88,67.06 39.37,67.06 38.99,67.44 36.45,67.44 v35.94,67.94 | U7.41 39.88,65.28 | U7.20 44.96,57.95 44.96,57.91 47.24,57.91 | U7.9 | U7.9 40.39,53.59 | U7.9 40.39,54.81
  Top 0.254: U7.25 46.58,60.45 46.69,60.55 47.95,60.55 v48.31,60.91
  Top 0.305: 40.39,53.59 40.39,53.49 40.64,53.24 41.12,53.24 v41.22,53.14
  other vias: 33.4,55.12 29.97,69.6 41.53,77.85 44.02,74.68 28.96,90.04 31.62,90.04 37.06,56.44 20.17,24.79 68.58,57.71 64.62,69.14 51.21,75.49 53.49,50.95 57.81,80.87 59.23,80.87 60.76,80.87 61.52,81.89 61.52,84.02 60.2,84.28
  pour Top (isolate 0.305, rank 5): 0,99.06 77.47,99.06 77.47,0 0,0
  pour Bottom (isolate 0.305, rank 5): 0,99.06 77.47,99.06 77.47,0 0,0
GPS-RX  (via drill 0.5)
  Top 0.203: R2.2 63.23,88.13 v63.5,88.39 | v62.1,50.8 TX2.C | U7.21 62.08,58.45 v62.36,58.17
  Bottom 0.203: v63.5,88.39 60.2,88.39 58.8,87 56.26,87 55.63,86.36 55.63,84.84 54.61,83.82 46.48,83.82 46.1,83.44 46.1,69.22 46.35,68.96 60.33,68.96 61.59,67.69 61.59,58.42 | 61.59,58.42 61.59,51.31 v62.1,50.8 | v62.36,58.17 62.1,58.42 61.59,58.42
GPS-TX  (via drill 0.5)
  Top 0.203: R1.2 58.03,88.13 v57.91,88.01 | v61.21,48.64 RX2.C | U7.22 59.91,58.95 v60.35,59.33
  Bottom 0.203: v57.91,88.01 55.75,88.01 54.99,87.25 54.99,85.09 54.36,84.45 45.97,84.45 45.47,83.95 45.47,68.83 45.97,68.33 60.07,68.33 60.96,67.44 60.96,59.13 | 60.96,59.13 60.96,48.9 v61.21,48.64 | v60.35,59.33 60.86,59.33 60.96,59.13
N$1
  Top 0.406: RX2.A R9.2
N$2
  Top 0.254: U1.25 59.29,90.95 59.69,90.55 59.69,90.05 R1.1
N$3
  Top 0.254: U1.17 59.64,82.95 SJ2.2 66.61,83 ANT1.C
N$4
  Top 0.254: U1.26 60.71,91.95 61.47,91.19 R2.1
N$5
  Top 0.254: U1.20 57.88,85.95 SJ1.2
N$6
  Bottom 0.61: D1.1 29.3,52.7 R3.2
N$7
  Top 0.254: R11.1 3V3.A
N$8  (via drill 0.6)
  Top 0.61: v49.66,86.11 49.66,85.34 49.28,84.96 47.3,84.96 U1.8
  Bottom 0.61: C3.+ R3.1 | R3.1 C2.1 | R3.1 31.33,48.35 32,49.02 32,72.9 33.53,74.42 41.53,74.42 43.43,76.33 43.43,85.22 44.32,86.11 v49.66,86.11
N$9
  Top 0.406: R6.2 RX3.A
N$10
  Top 0.406: R8.2 TX3.A
N$11
  Top 0.203: TX5.A R18.1
N$12  (via drill 0.5)
  Top 0.203: 64.39,52.84 R14.2 64.12,52.58 v57.61,52.58 | U7.28 56.31,61.95 v56.54,61.72
  Bottom 0.203: v56.54,61.72 56.54,58.73 58.22,57.05 58.22,53.19 v57.61,52.58
N$13
  Top 0.203: U7.40 40.38,69.22 39.37,70.23 38.48,70.23 38.35,70.1 Y1.3 36.19,70.22 C16.1
N$14
  Top 0.203: U7.39 40.88,69.35 40.51,69.72 40.51,72.01 40.77,72.26 41.98,72.26 Y1.1 44.33,72.52 C15.1
N$15
  Top 0.203: R14.1 LED2.A
N$16
  Top 0.203: U7.31 45.01,63.45 44.83,63.63 44.83,64.39 45.09,64.64 51.69,64.64 51.94,64.9 51.94,65.92 R7.1
  Top 0.254: U8.5 51.9,65.96 R7.1
N$17
  Top 0.254: U1.16 59.54,81.95 SJ2.1
N$18
  Top 0.254: RX5.A 28.8,26.84 R19.1
N$19
  Top 0.203: U15.7 17.19,19.85 TX5.C
N$20
  Top 0.254: RX5.C 25.17,22.37 U15.14
N$21
  Top 0.254: U15.4 21.25,21.75 21.74,22.25 21.74,25.76 U4.2
N$22
  Top 0.406: RX1.A R4.2
N$23
  Top 0.406: R5.2 69.65,46.48 69.55,46.58 69.1,46.58 TX1.A
N$24
  Top 0.406: TX2.A R10.2
N$27
  Top 0.254: U15.1 19.42,23.66 19.2,23.88 19.2,26.98 19.56,27.33 22.2,27.33 22.4,27.13 22.4,25.81 U4.3
N$28
  Top 0.203: JP13.3 22.91,18.64 23.47,19.2 25.13,19.2 U15.9
N$32
  Top 0.203: U7.32 54.55,63.95 55.12,64.52 U8.6
  Top 0.254: R20.1 54.61,68.2 55.12,67.69 U8.6
N$33
  Top 0.254: R43.1 VIN.A
N$61
  Top 0.203: JP13.2 20.37,18.71 U15.8
N$62
  Top 0.254: U15.16 25.15,24.64 SJ3.2
N$69
  Top 0.203: U4.7 21.72,31.57 21.08,32.21 19.78,32.21 R29.1
N$85  (via drill 0.5)
  Top 0.254: U15.12 23.94,21.12 v23.47,21.59 | JP13.4 25.5,14.66 C19.A 28.85,14.62 C20.1
  Bottom 0.254: v23.47,21.59 23.52,21.59 23.98,21.13 25.25,21.13 25.5,20.88 25.5,14.76 JP13.4
N$86
  Bottom 0.305: R25.1 70.36,71.53 | C7.1 70.59,74.24 70.87,73.97 70.87,72.77
  Bottom 0.406: ICSP.1 74.18,64.4 R15.1 70.36,65.29 70.36,71.53 70.36,72.26 70.87,72.77 74.3,72.77 74.93,73.41 S2.2
N$87  (via drill 0.5)
  Top 0.203: v62.59,53.8 45.16,53.8 43.69,52.22 39.88,52.22 39.37,52.73 39.37,54.44 U7.7
  Bottom 0.203: 63.45,64.31 63.45,57.51 62.18,56.24 62.18,54.2 v62.59,53.8
  Bottom 0.254: 63.45,64.31 63.45,70.46 64.52,71.53 68.52,71.53 R25.2
N$88  (via drill 0.5)
  Top 0.203: U7.56 35.68,60.45 v35.94,60.45
  Bottom 0.254: v35.94,60.45 34.29,60.45 34.04,60.2 C6.A
N$90
  Top 0.203: U7.15 43.38,55.07 43.69,55.37 45.34,55.37 45.59,55.12 55.5,55.12 55.75,55.37 70.87,55.37 72.52,57.02 74.17,57.02 ICSP.4
N$91
  Top 0.203: U7.16 55.84,54.45 56.13,54.74 74.42,54.74 ICSP.5
RS-TM-A  (via drill 0.6)
  Top 0.254: v19.43,70.23 15.11,70.23 14.73,69.85 14.73,64.26 15.11,63.88 U3.8
  Bottom 0.254: CARD2.35 12.32,83.82 18.92,77.22 18.92,70.74 v19.43,70.23
RS-TM-B  (via drill 0.6)
  Top 0.254: v18.67,68.45 18.67,68.07 19.68,67.06 19.68,65.66 19.18,65.15 U3.7
  Bottom 0.254: CARD2.36 13.46,81.28 18.16,76.58 18.16,68.96 v18.67,68.45
RS-TM-Y  (via drill 0.6)
  Top 0.254: v16.51,69.09 16.51,67.72 U3.5
  Bottom 0.254: CARD2.38 15.49,76.2 16.51,75.18 v16.51,69.09
RS-TM-Z  (via drill 0.6)
  Top 0.254: v18.54,66.42 U3.6
  Bottom 0.254: CARD2.37 14.99,78.74 17.53,76.2 17.53,66.93 v18.54,66.42
RX  (via drill 0.5)
  Top 0.203: U7.52 35.02,62.45 35.33,62.46 41.25,62.46 42.8,60.96 42.8,56.26 v42.88,56.19 | v70,33.73 62.94,33.73 62.48,33.33 41.96,33.33 40.59,34.59 38.96,34.59 v38.61,34.9
  Bottom 0.203: v42.88,56.19 42.93,56.19 43.43,55.68 43.43,39.73 43.03,39.32 39.88,39.32 38.61,38 v38.61,34.9 | S1.P1 75.69,32.26 76.1,32.66 76.1,35.1 75.74,35.46 70.81,35.46 70.36,35 70.36,34.09 v70,33.73
RXD0
  Top 0.203: JP3.2 27.72,57.95 U7.61 35.02,57.95 35.31,57.66 35.31,46.23 36.45,45.09 63.63,45.09 64.64,44.07 66.64,44.07 RX1.C
  Top 0.254: U2.1 25.91,56.13 JP3.2
RXD2  (via drill 0.5)
  Top 0.203: JP2.2 28.96,64.39 29.34,64.01 29.34,61.85 30.35,60.83 33.53,60.83 33.64,60.95 U7.55 35.06,60.95 35.74,61.47 40.64,61.47 41.66,60.45 41.66,58.42 40.89,57.66 40.89,56.59 v40.84,56.54 | v41.71,42.27 53.14,42.27 53.49,42.62 53.49,43.64 54,44.15 60.91,44.15 61.82,43.23 61.82,42.47 62.13,42.16 RX3.C
  Top 0.254: U3.2 25.65,65.15 JP2.2
  Bottom 0.203: v40.84,56.54 40.84,55.88 42.22,54.51 42.22,42.77 v41.71,42.27
RXD3  (via drill 0.5)
  Top 0.254: U4.6 22.37,31.16 23.37,32.16 70.71,32.16 v71.42,31.45
  Bottom 0.254: v71.42,31.45 71.42,29.62 71.98,29.06 73.71,29.06 S1.P1-TA
RXD4
  Top 0.254: U5.2 58.05,34.86 58.52,34.39 61.67,34.39 62.79,35.51 73.66,35.51 S1.P1-TB
SETUP  (via drill 0.5)
  Top 0.203: U7.24 46.59,59.95 46.63,59.99 57.15,59.99 v57.96,60.81
  Bottom 0.254: v57.96,60.81 57.96,58.42 59.08,57.3 59.08,38 59.84,37.24 61.16,37.24 61.87,36.52 61.87,16.46 61.16,15.75 42.57,15.75 41.96,15.14 41.96,13.73 U5.11
TSA
  Top 0.254: CARD2.11 13.72,63.5 14.61,62.61 14.61,59.18 15.11,58.67 U2.6
TSB
  Top 0.254: CARD2.12 13.59,60.96 13.97,60.58 13.97,57.91 14.48,57.4 U2.7
TX  (via drill 0.5)
  Top 0.203: U7.51 35.01,62.95 35.31,63.25 41.4,63.25 43.43,61.21 43.43,57.1 43.54,57 43.99,57 v44.09,56.9 | S1.P2 71.93,32.26 71.37,32.82 40.59,32.82 v40.13,33.27
  Bottom 0.203: v44.09,56.9 44.09,39.47 43.33,38.71 40.18,38.71 39.47,38 39.47,33.83 40.03,33.27 v40.13,33.27
TXD0
  Top 0.203: JP3.1 27.4,58.45 U7.60 35.46,58.45 35.74,58.17 35.74,46.86 37.01,45.59 64.64,45.59 65.53,46.48 TX1.C
  Top 0.254: U2.4 25.91,59.94 JP3.1
TXD2  (via drill 0.5)
  Top 0.203: 26.92,67.06 29.08,67.06 29.97,66.17 29.97,62.1 30.63,61.45 U7.54 34.96,61.45 35.64,61.98 40.89,61.98 42.16,60.71 42.16,57.61 v41.86,57.3 | v42.32,40.39 53.7,40.39 54.15,40.84 54.15,43.08 54.61,43.54 60.5,43.54 61.01,43.03 61.01,40.39 61.42,39.98 66.87,39.98 TX3.C
  Top 0.254: U3.3 26.29,66.42 26.92,67.06 26.54,67.06 JP2.1
  Bottom 0.203: v41.86,57.3 41.86,55.73 42.82,54.76 42.82,40.84 v42.32,40.39
TXD3
  Top 0.254: S1.P2-TA 71.14,30.26 69.9,31.5 23.67,31.5 23.01,30.84 U4.5
TXD4
  Top 0.254: U5.3 56.05,34.67 56.9,33.78 62.08,33.78 62.94,34.65 72.53,34.65 S1.P2-TB
U3-EN  (via drill 0.6)
  Top 0.203: U7.59 30.97,58.95 v30.48,59.44 | v19.94,58.17 19.94,58.42 20.32,58.8 21.92,58.8 U2.3
  Top 0.254: U2.2 U2.3
  Bottom 0.203: v30.48,59.44 30.48,58.67 29.97,58.17 v19.94,58.17

### Text on the board
tNames: TM / "Telemetry Master"
_tsilk: + | VIN | R1 | R2 | R43 | R11 | + | C1 | 3V3 | ANT1 | SJ1 | U9 | C17 | SJ2 | C12 | U1 | Y1 | C15 | U3 | C16 | U8 | S2 | R20 | JP2 | R7 | ICSP | C5 | JP3 | U2 | R14 | LED2 | + | C3 | U7 | C4 | TX2 | R10 | + | RX2 | R9 | + | TM "Telemetry Master" | TX1 | + | R5 | RX1 | + | R4 | C14 | RX3 | + | R6 | TX3 | + | R8 | C13 | + | 1 | R29 | SJ3 | R19 | RX5 | TX5 | R18 | C18 | U15 | C20 | C19
_bsilk: C7 | R25 | C11 | R15 | C24 | C10 | C6 | C9 | D1 | C8 | R3 | C2